# EasyEDA Pro project FPGA-G1.eprj, board logi Pi (continued)
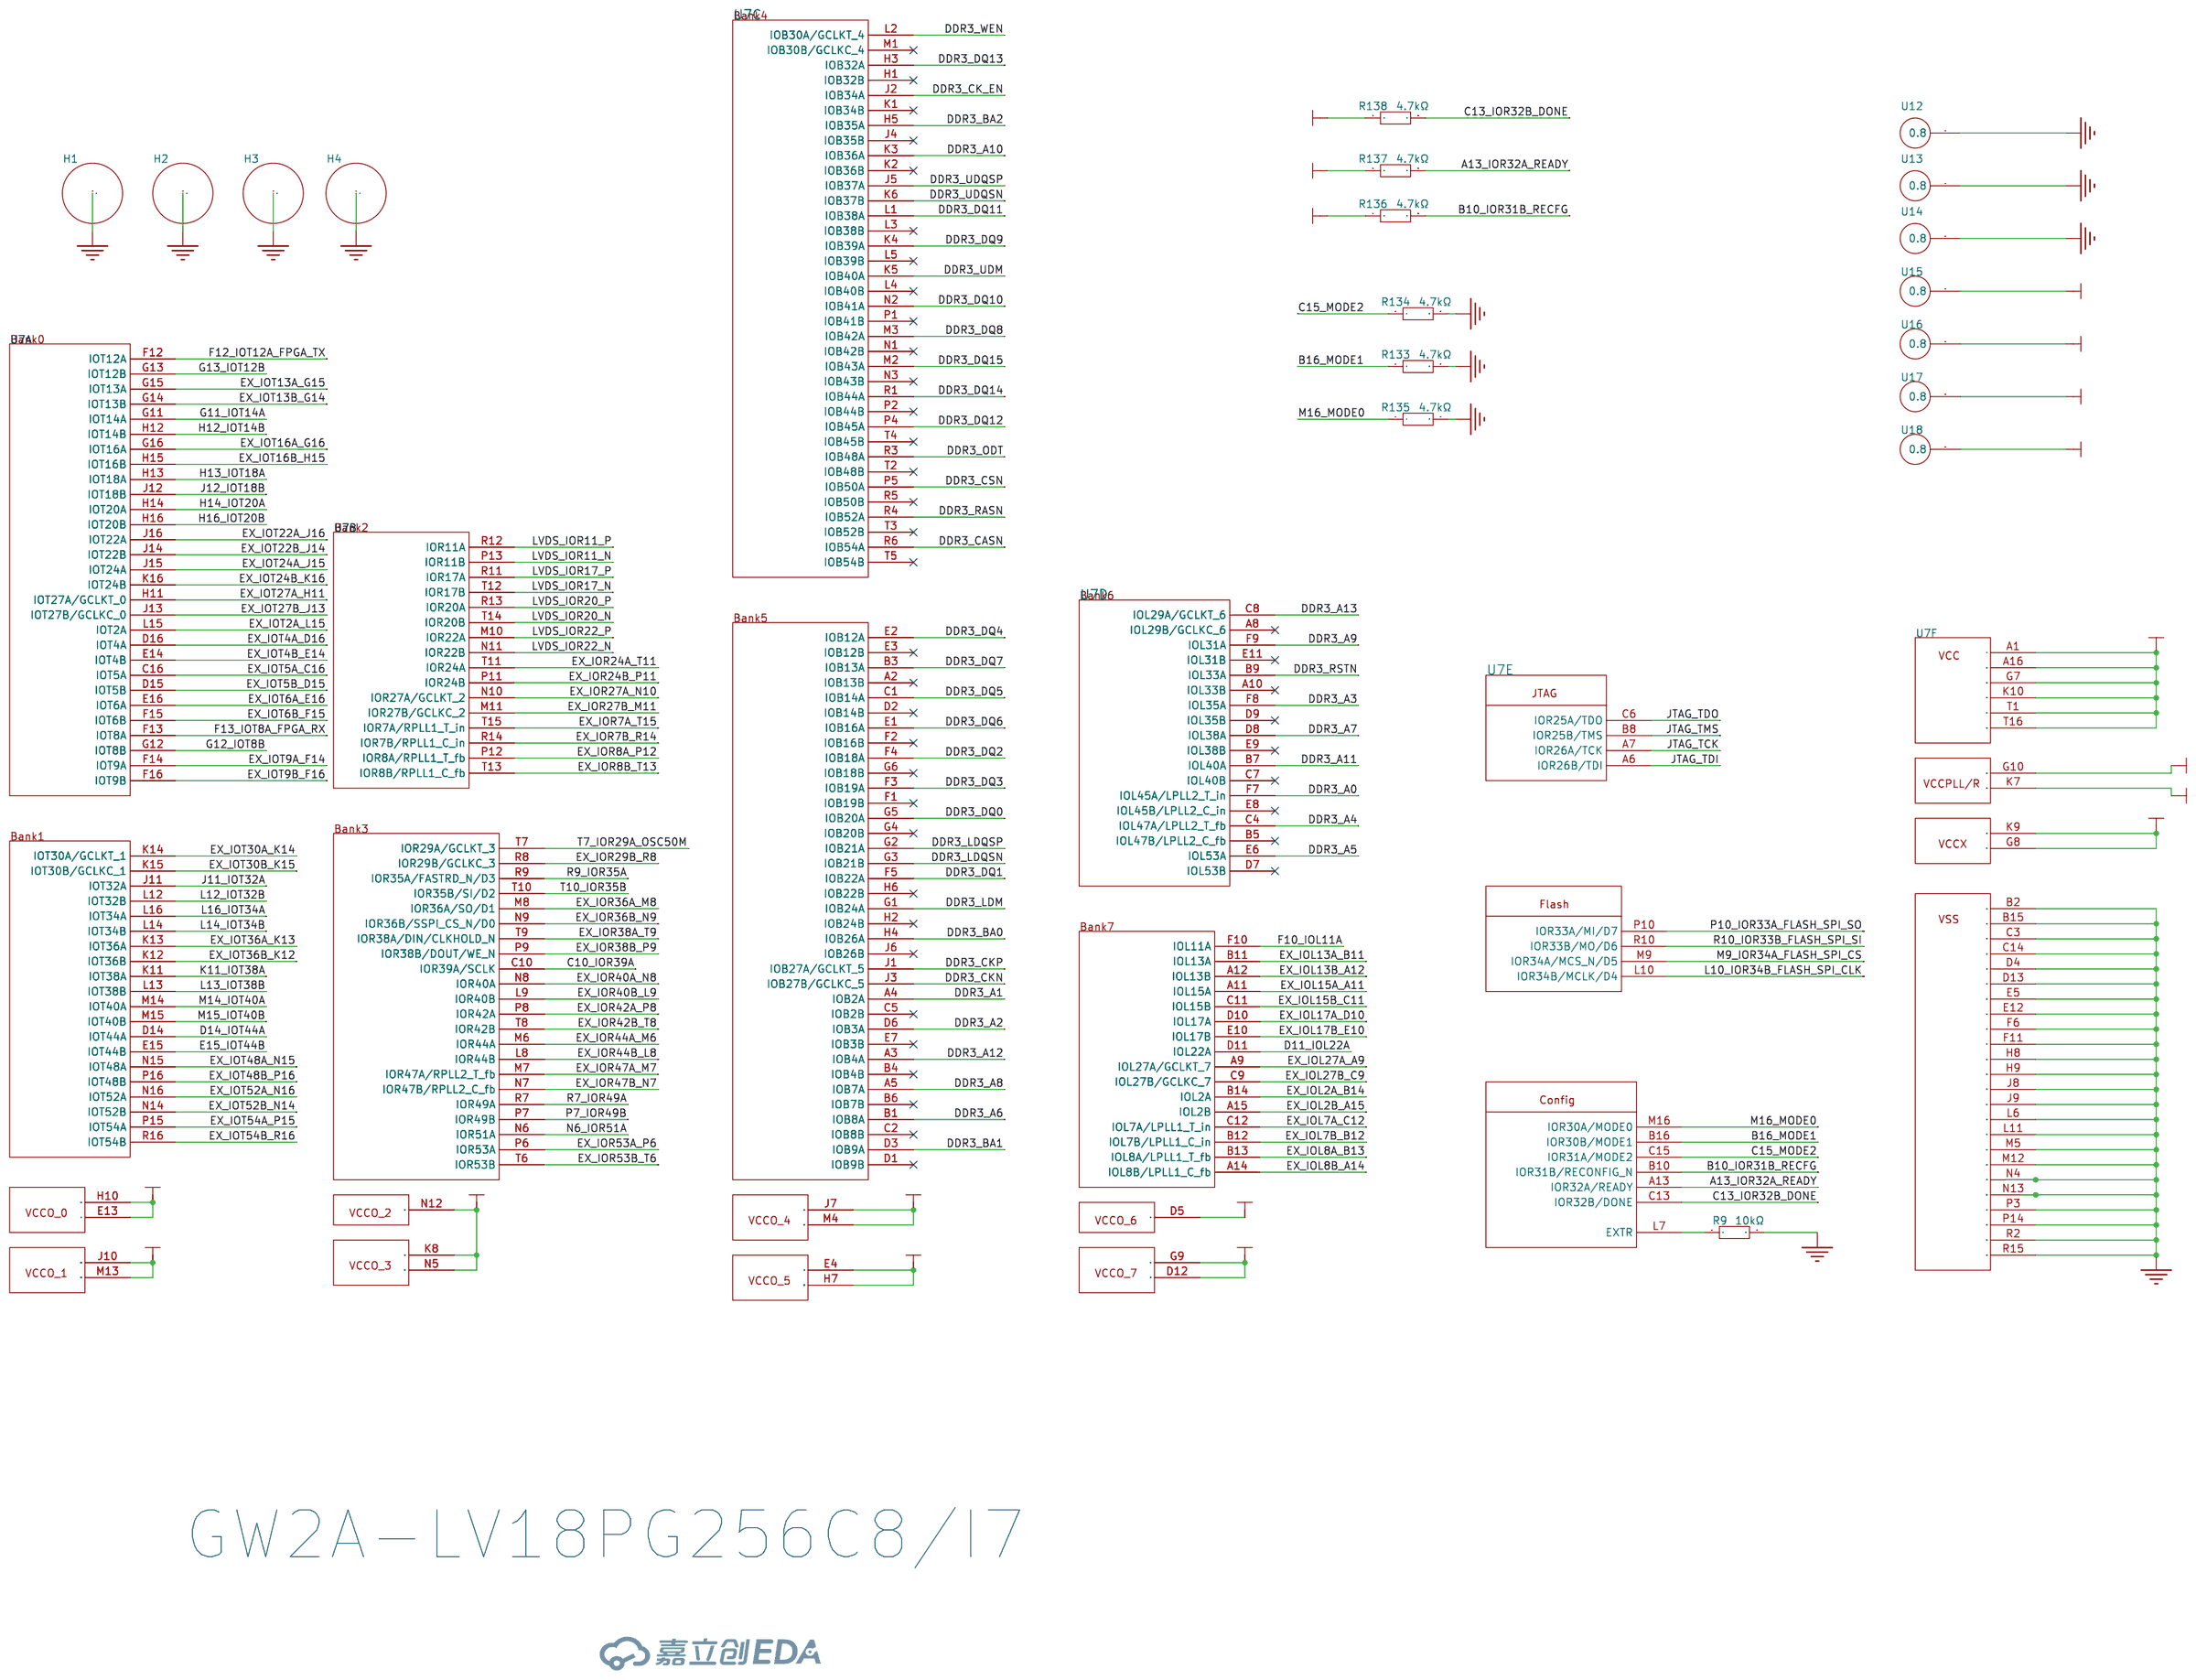
[diagram p0: FPGA]
## Routing (per net, layer and track width the routed paths; a pad name or vN(x,y) marks a point on that pad's centre or on a via; arc(x,y) is an arc through that point) (continued)
DDR3_DQ9: length 17.6
  Top Layer w0.109: U7.K4 v1(22.7,34.09) ; v1(13.53,31.44) 13.53,31.41 U29.C3
  Bottom Layer w0.109: v1(13.53,31.44) 13.55,31.44 14.38,32.27 14.54,32.27 14.92,32.65 15.07,32.65 15.15,32.73 15.15,32.88 15.22,32.96 15.4,32.96 15.47,32.88 15.47,32.73 15.55,32.65 17.46,32.65 17.7,32.89 17.7,33 17.7,33.01 17.7,33.12 17.82,33.24 17.93,33.24 17.93,33.23 18.04,33.23 18.17,33.36 18.17,33.47 18.16,33.47 18.16,33.58 18.28,33.7 18.39,33.7 18.4,33.7 18.51,33.7 18.74,33.93 20.01,33.93 20.16,34.08 20.16,34.66 20.39,34.89 20.78,34.89 20.86,34.97 20.86,35.54 20.94,35.62 21.11,35.62 21.19,35.53 21.19,34.73 21.27,34.66 21.44,34.66 21.52,34.73 21.52,35.54 21.59,35.62 21.76,35.62 21.84,35.54 21.84,34.97 21.92,34.89 22.27,34.89 22.38,34.77 22.38,34.33 22.62,34.09 22.7,34.09
DDR3_DQ10: length 17.7
  Top Layer w0.109: v1(20.7,30.09) 20.7,31.09 U7.N2 ; U29.C8 v1(10.3,29.84)
  Bottom Layer w0.109: v1(20.7,30.09) 20.11,29.5 19.67,29.5 17.37,27.2 13.07,27.2 12.99,27.12 12.99,26.9 12.91,26.83 12.74,26.83 12.66,26.9 12.66,27.12 12.59,27.2 12.41,27.2 12.33,27.12 12.33,26.9 12.26,26.83 12.08,26.83 12.01,26.9 12.01,27.12 11.93,27.2 10.73,27.2 9.91,28.02 9.91,29.45 v1(10.3,29.84)
DDR3_DQ11: length 17.6
  Top Layer w0.109: U29.C2 15.1,29.84 14.53,29.84 14.22,29.52 13.56,29.52 13.18,29.91 13.18,30.3 v1(13.53,30.65) ; 20.2,33.59 19.77,33.59 v1(19.27,33.09)
  Bottom Layer w0.109: v1(13.53,30.65) 13.53,30.92 13.65,31.05 13.99,31.05 14.06,30.97 14.06,30.59 14.14,30.51 14.31,30.51 14.39,30.59 14.39,30.97 14.47,31.05 14.64,31.05 14.72,30.97 14.72,30.59 14.8,30.51 14.97,30.51 15.05,30.59 15.05,30.97 15.12,31.05 17.39,31.05 17.51,30.93 17.51,30.93 17.55,30.88 17.66,30.88 17.79,31 17.79,31.11 17.52,31.38 17.52,31.49 17.64,31.61 17.75,31.61 18.03,31.33 18.12,31.33 18.29,31.5 18.29,31.61 18.1,31.8 18.1,31.92 18.25,32.07 18.31,32.07 18.52,31.86 18.63,31.86 18.76,31.98 18.76,32.09 18.58,32.27 18.58,32.4 18.84,32.66 19.85,32.66 20.04,32.85 20.04,33.11 19.87,33.28 19.46,33.28 v1(19.27,33.09)
DDR3_DQ12: length 17.7
  Top Layer w0.109: U29.A7 v1(11.9,28.24) ; U7.P4 v1(22.7,30.09)
  Bottom Layer w0.109: v1(22.7,30.09) 22.7,29.7 22.77,29.63 23.09,29.63 23.2,29.74 23.2,30.38 23.04,30.54 19.61,30.54 16.93,27.86 16.39,27.86 15.92,28.33 13.8,28.33 13.5,28.63 13.5,29.04 13.42,29.12 13.04,29.12 12.96,29.04 12.96,28.62 12.85,28.51 12.72,28.51 12.58,28.64 12.58,28.99 12.5,29.08 12.2,29.08 12.1,28.98 12.1,28.45 v1(11.9,28.24)
DDR3_DQ13: length 17.7
  Top Layer w0.109: U29.A2 15.12,28.26 14.37,28.26 12.85,29.77 12.85,30.62 ; v1(21.82,37.05) 22.2,36.67 U7.H3
  Bottom Layer w0.109: v1(21.82,37.05) 21.23,37.05 20.09,35.91 18.6,35.91 18.36,35.67 18.36,34.28 17.5,33.43 15.23,33.43 14.46,32.66 14.2,32.66 12.85,31.31 v1(12.85,30.64)
DDR3_DQ14: length 17.7
  Top Layer w0.109: U29.B8 v1(10.3,29.04) ; 20.2,29.58 v1(19.7,30.08)
  Bottom Layer w0.109: v1(19.7,30.08) 19.62,30.08 17.06,27.53 15.96,27.53 15.86,27.63 15.86,27.89 15.78,27.97 15.64,27.97 15.56,27.89 15.56,27.64 15.48,27.56 15.31,27.56 15.23,27.64 15.23,27.91 15.16,27.98 14.98,27.98 14.91,27.91 14.91,27.64 14.83,27.56 14.65,27.56 14.58,27.64 14.58,27.91 14.5,27.98 14.33,27.98 14.25,27.91 14.25,27.64 14.17,27.56 14,27.56 13.92,27.64 13.92,27.91 13.84,27.98 13.67,27.98 13.59,27.91 13.59,27.64 13.52,27.56 13.34,27.56 13.27,27.64 13.27,28.03 13.19,28.11 13.02,28.11 12.94,28.03 12.94,27.64 12.86,27.56 12.69,27.56 12.61,27.64 12.61,28.03 12.53,28.11 12.36,28.11 12.28,28.03 12.28,27.64 12.21,27.56 12.1,27.56 11.8,27.86 11.68,27.86 11.55,27.73 11.41,27.73 11.3,27.84 11.3,28.01 11.52,28.23 11.52,28.34 11.39,28.46 11.28,28.46 11.14,28.31 11.03,28.31 v1(10.3,29.04)
DDR3_DQ15: length 17.7
  Top Layer w0.109: U29.A3 v1(14.3,29.04) ; U7.M2 v1(21.7,32.09)
  Bottom Layer w0.109: v1(14.3,29.04) 14.23,29.11 13.93,29.11 13.82,29 13.82,28.77 13.93,28.66 17.26,28.66 19.47,30.87 19.76,30.87 19.83,30.94 19.83,31.23 19.91,31.31 20.08,31.31 20.16,31.23 20.16,30.94 20.24,30.87 20.41,30.87 20.49,30.94 20.49,31.71 20.57,31.79 20.74,31.79 20.82,31.71 20.82,30.94 20.89,30.87 21.07,30.87 21.15,30.94 21.15,31.71 21.22,31.79 21.4,31.79 21.47,31.71 21.47,31.53 21.53,31.48 21.87,31.48 21.94,31.41 21.94,31.25 21.87,31.19 21.6,31.19 21.49,31.08 21.49,30.92 21.55,30.87 21.99,30.87 ; v1(21.7,32.09) 22.07,32.09 22.24,31.93 22.24,31.11 21.99,30.87
DDR3_LDM: length 21.3
  Top Layer w0.109: U29.E7 12.11,31.84 12.35,32.08 12.35,33.5 v1(11.96,33.88) ; U7.G1 v1(19.7,38.09)
  SIG03 w0.109: v1(11.96,33.88) 12.25,34.17 12.36,34.17 12.54,33.99 12.65,33.99 12.77,34.11 12.77,34.22 12.59,34.4 12.59,34.51 13.36,35.28 13.36,35.66 13.44,35.74 14.11,35.74 14.19,35.81 14.19,35.99 14.11,36.06 13.44,36.06 13.36,36.14 13.36,36.31 13.44,36.39 14.01,36.39 14.09,36.47 14.09,36.64 14.01,36.72 13.44,36.72 13.36,36.8 13.36,37.22 13.6,37.45 13.65,37.45 13.73,37.53 13.73,37.83 13.81,37.91 13.98,37.91 14.06,37.83 14.06,37.53 14.14,37.45 14.31,37.45 14.39,37.53 14.39,37.8 14.46,37.88 14.64,37.88 14.72,37.8 14.72,37.53 14.79,37.45 16.11,37.45 16.19,37.53 16.19,37.59 16.27,37.67 16.44,37.67 16.52,37.59 16.52,37.53 16.6,37.45 16.77,37.45 16.85,37.53 16.85,37.68 16.92,37.76 17.1,37.76 17.18,37.68 17.18,37.53 17.25,37.45 17.43,37.45 17.5,37.53 17.5,37.63 17.58,37.7 17.75,37.7 17.83,37.63 17.83,37.53 17.91,37.45 18.38,37.45 18.53,37.3 18.53,36.85 18.66,36.72 18.97,36.72 ; 18.97,36.72 19.15,36.9 19.15,37.12 19.7,37.67 v1(19.7,38.09)
DDR3_LDQSN: length 21.2
  Top Layer w0.104: U29.G3 v1(14.3,33.04) ; v1(21.66,38.09) 22.16,37.59 U7.G3
  SIG03 w0.104: v1(14.3,33.04) 14.05,33.29 14.05,34.63 14.17,34.75 14.6,34.75 14.85,35 14.85,36.27 14.92,36.34 15.1,36.34 15.18,36.27 15.18,35 15.43,34.75 17.33,34.75 17.58,35 17.58,36.75 17.65,36.82 17.83,36.82 17.91,36.75 17.91,35 18.16,34.75 18.71,34.75 19.16,35.2 19.16,35.61 18.91,35.86 18.91,35.96 19.04,36.09 19.15,36.09 19.4,35.84 19.75,35.84 20.06,36.15 20.06,36.5 19.81,36.76 19.81,36.86 19.94,36.99 20.04,36.99 20.49,36.53 20.78,36.53 21.11,36.86 21.11,37.48 21.66,38.04 v1(21.66,38.09)
DDR3_LDQSP: length 21.2
  Top Layer w0.104: 21.2,37.57 v1(20.7,38.07) ; v1(13.5,33.04) 13.9,32.64 U29.F3
  SIG03 w0.104: v1(13.5,33.04) 13.75,33.29 13.75,34.76 14.04,35.05 14.47,35.05 14.55,35.13 14.55,36.39 14.8,36.64 15.23,36.64 15.48,36.39 15.48,35.13 15.56,35.05 17.2,35.05 17.27,35.13 17.27,36.87 17.53,37.13 17.96,37.13 18.21,36.87 18.21,35.13 18.28,35.05 18.48,35.05 18.81,35.38 18.81,35.54 18.61,35.73 18.61,36.09 18.91,36.4 19.27,36.4 19.52,36.15 19.63,36.15 19.75,36.27 19.75,36.38 19.5,36.63 19.5,36.99 19.81,37.29 20.17,37.29 20.42,37.04 20.52,37.04 20.71,37.23 20.71,38.07 v1(20.7,38.07)
DDR3_ODT: length 22.2
  Top Layer w0.109: U29.K1 16.7,36.24 ; U7.R3 v1(21.7,29.09)
  SIG04 w0.109: 16.7,36.24 16.95,36.24 17.85,37.14 21.15,37.14 21.9,36.4 22.01,36.4 22.24,36.63 22.35,36.63 22.47,36.51 22.47,36.4 22.24,36.16 22.24,36.06 22.49,35.81 22.49,34.98 23.09,34.38 23.09,33.19 22.32,32.42 22.32,31.56 22.24,31.49 20.9,31.49 20.83,31.41 20.83,31.24 20.9,31.16 22.24,31.16 22.32,31.08 22.32,30.91 22.24,30.83 20.75,30.83 20.67,30.75 20.67,30.58 20.75,30.5 22.24,30.5 22.32,30.43 22.32,29.71 v1(21.7,29.09)
  vias: v1(16.7,36.24)
DDR3_RASN: length 32.1
  Top Layer w0.109: U7.R4 v1(22.7,29.09) ; v1(13.22,34.32) 13.22,34.38 13.88,35.04 U29.J3
  SIG04 w0.109: v1(22.7,29.09) 22.09,28.48 20.38,28.48 19.21,29.64 18.08,29.64 18,29.72 18,29.98 17.93,30.06 17.75,30.06 17.68,29.98 17.68,29.72 17.6,29.64 17.43,29.64 17.35,29.72 17.35,29.98 17.27,30.06 17.1,30.06 17.02,29.98 17.02,29.72 16.94,29.64 16.77,29.64 16.69,29.72 16.69,29.98 16.62,30.06 16.44,30.06 16.36,29.98 16.36,29.72 16.29,29.64 16.11,29.64 16.04,29.72 16.04,29.98 15.96,30.06 15.79,30.06 15.71,29.98 15.71,29.72 15.63,29.64 15.46,29.64 15.38,29.72 15.38,29.98 15.3,30.06 15.13,30.06 15.05,29.98 15.05,29.72 14.98,29.64 14.8,29.64 14.73,29.72 14.73,29.98 14.65,30.06 14.48,30.06 14.4,29.98 14.4,29.72 14.32,29.64 13.13,29.64 12.38,30.39 12.38,33.79 12.91,34.32 v1(13.22,34.32)
  Bottom Layer w0.109: v1(13.22,34.32) 12.75,34.79 12.75,37.72 12.43,38.04 12.43,40.56 10.13,42.85 R128.1
DDR3_RSTN: length 26.1
  Top Layer w0.109: 15.9,41.05 16.7,41.85 v1(16.7,41.91) ; 15.9,41.05 18.47,43.6 18.47,43.63 ; 15.9,41.05 15.5,40.65 U29.T2 ; U7.B9 v1(27.7,42.09)
  SIG04 w0.109: v1(16.7,41.91) 17.85,43.05 17.96,43.05 18.12,42.9 18.22,42.9 18.35,43.02 18.35,43.13 18.19,43.29 18.19,43.39 18.31,43.52 18.42,43.52 18.58,43.36 18.69,43.36 18.81,43.48 18.81,43.59 18.65,43.75 18.65,43.86 19.22,44.43 20.22,44.43 20.3,44.35 20.3,43.96 20.38,43.88 20.55,43.88 20.63,43.96 20.63,44.35 20.71,44.43 20.88,44.43 20.96,44.35 20.96,43.96 21.03,43.88 21.21,43.88 21.28,43.96 21.28,44.35 21.36,44.43 21.53,44.43 21.61,44.35 21.61,43.96 21.69,43.88 21.86,43.88 21.94,43.96 21.94,44.35 22.02,44.43 23.68,44.43 23.99,44.12 23.99,44.02 23.83,43.86 23.83,43.76 23.96,43.63 24.07,43.63 24.22,43.78 24.33,43.78 25.51,42.6 25.92,42.6 26.15,42.37 26.15,40.96 26.46,40.64 27.13,40.64 27.7,41.21 v1(27.7,42.09)
DDR3_UDM: length 17.7
  Top Layer w0.109: U29.D3 v1(14.3,31.44) ; U7.K5 24.2,34.76 v1(23.7,35.27)
  Bottom Layer w0.109: v1(14.3,31.44) 14.3,31.72 14.41,31.83 14.76,31.83 14.84,31.9 14.84,32.11 14.91,32.19 15.09,32.19 15.17,32.11 15.17,31.9 15.24,31.83 17.34,31.83 17.68,32.16 17.68,32.36 17.81,32.49 18.01,32.49 18.14,32.62 18.14,32.82 18.27,32.96 18.47,32.96 18.6,33.09 18.6,33.29 18.74,33.42 18.94,33.42 19.12,33.61 20.1,33.61 20.17,33.53 20.17,33.44 20.25,33.37 20.42,33.37 20.5,33.44 20.5,33.53 20.58,33.61 20.99,33.61 21.07,33.68 21.07,33.85 21.15,33.93 21.32,33.93 21.4,33.85 21.4,33.68 21.47,33.61 21.97,33.61 22.05,33.68 22.05,33.87 22.13,33.95 22.3,33.95 22.38,33.87 22.38,33.68 22.46,33.61 23.41,33.61 23.7,33.89 23.7,34.38 23.62,34.46 22.96,34.46 22.71,34.71 22.71,34.99 22.82,35.1 23.03,35.1 23.35,34.79 23.62,34.79 23.7,34.87 v1(23.7,35.27)
DDR3_UDQSN: length 17.6
  Top Layer w0.104: U7.K6 v1(24.7,34.09) ; U29.B7 v1(11.1,29.04)
  Bottom Layer w0.104: v1(11.1,29.04) 11.38,29.04 11.63,29.29 11.95,29.29 12.19,29.52 17.67,29.52 21.12,32.98 21.68,32.98 21.75,32.9 21.75,32.75 21.83,32.68 22.01,32.68 22.08,32.75 22.08,32.9 22.15,32.98 24.04,32.98 24.7,33.64 v1(24.7,34.09)
DDR3_UDQSP: length 17.6
  Top Layer w0.104: 24.2,35.62 24.7,35.12 ; U29.C7 v1(11.1,29.84)
  Bottom Layer w0.104: 24.73,35.08 v1(24.72,35.09) 24.72,34.74 24.18,34.19 24.18,33.92 23.54,33.28 21,33.28 17.54,29.83 12.06,29.83 11.83,29.59 11.51,29.59 11.26,29.84 v1(11.1,29.84)
DDR3_WEN: length 29.4
  Top Layer w0.109: v1(15.1,37.03) 14.7,36.64 U29.L3 ; U7.L2 v1(20.7,34.09)
  SIG04 w0.109: v1(15.1,37.03) 15.06,37 15.06,36.03 15.26,35.83 17.02,35.83 18.01,36.82 21.01,36.82 22.16,35.67 22.16,33.75 22.24,33.68 22.34,33.68 22.42,33.6 22.42,33.43 22.34,33.35 22.24,33.35 22.16,33.27 22.16,32.73 21.99,32.55 21.82,32.55 21.75,32.63 21.75,33.34 21.67,33.42 21.5,33.42 21.42,33.34 21.42,32.55 21.34,32.48 21.17,32.48 21.09,32.55 21.09,33.34 21.01,33.42 20.84,33.42 20.76,33.33 20.76,31.81 20.59,31.64 20.39,31.64 20.26,31.77 20.26,33.42 20.7,33.86 v1(20.7,34.09)
  Bottom Layer w0.109: R129.1 13.08,41.79 13.08,39.05 15.09,37.03
E15_IOT44B: length 18.9
  Top Layer w0.109: v1(34.68,40.09) 34.2,39.62 U7.E15 ; v1(35.84,50.75) 35.84,50.75 35.84,51.44 35.55,51.73 34.98,51.73 34.79,51.54 33.91,51.54 33.21,52.24 33.21,53.67 33.5,53.96 U1.14
  SIG04 w0.109: v1(35.84,50.75) 35.24,50.75 34.46,49.96 34.46,40.32 v1(34.68,40.09)
EX_IOL2A_B14: length 46.8
  Top Layer w0.104: v1(32.2,44.82) 32.98,44.82 33.7,44.09 33.7,43.09 U7.B14
  SIG03 w0.104: H5.17 4.52,40.27 4.6,40.34 4.6,41.46 4.85,41.71 6.63,41.71 7.52,42.6 7.52,43.45 11.13,47.06 11.13,49.76 13.78,52.41 21.96,52.41 22.21,52.15 22.21,51.59 22.29,51.52 22.47,51.52 22.54,51.59 22.54,52.15 22.79,52.41 27.56,52.41 32.68,47.28 32.68,44.96 32.54,44.82 v1(32.2,44.82)
EX_IOL2B_A15: length 46.8
  Top Layer w0.104: U7.A15 34.2,44.09 32.85,45.44 v1(32.2,45.44)
  SIG03 w0.104: v1(32.2,45.44) 32.38,45.44 32.38,47.16 31.03,48.51 30.92,48.51 30.69,48.28 30.59,48.28 30.46,48.41 30.46,48.51 30.69,48.74 30.69,48.85 30.56,48.97 30.46,48.97 30.23,48.75 30.13,48.75 30,48.87 30,48.98 30.23,49.2 30.23,49.31 30.1,49.44 30,49.44 29.77,49.21 29.66,49.21 29.54,49.34 29.54,49.44 29.76,49.67 29.76,49.77 27.43,52.1 22.92,52.1 22.84,52.03 22.84,51.46 22.59,51.21 22.16,51.21 21.91,51.46 21.91,52.03 21.83,52.1 13.91,52.1 11.45,49.65 11.45,46.66 7.83,43.04 7.83,42.48 6.76,41.4 4.97,41.4 4.9,41.33 4.9,40.34 4.97,40.27 H5.18
EX_IOL7A_C12: length 46.9
  Top Layer w0.104: U7.C12 v1(31.7,42.09)
  SIG03 w0.104: v1(31.7,42.09) 31.35,42.44 31.12,42.44 30.4,43.16 30.4,44.05 29.97,44.47 26.49,44.47 25.83,45.14 25.83,45.98 25.32,46.49 24.85,46.49 24.6,46.74 24.6,48.13 24.53,48.21 24.34,48.21 24.27,48.13 24.27,46.74 23.99,46.46 20.37,46.46 19,47.82 18.67,47.82 18.6,47.75 18.6,46.96 18.35,46.71 17.91,46.71 17.66,46.96 17.66,47.75 17.59,47.82 17.41,47.82 17.34,47.75 17.34,46.96 17.08,46.71 16.65,46.71 16.4,46.96 16.4,47.75 16.32,47.82 16.32,47.82 15.71,47.82 14.88,46.99 14.88,46.88 14.91,46.85 14.91,46.74 14.79,46.61 14.68,46.61 14.65,46.65 14.54,46.65 8.62,40.73 8.62,37.02 7.89,36.28 5.19,36.28 4.9,35.99 4.9,35.26 4.97,35.19 H5.22
EX_IOL7B_B12: length 46.9
  Top Layer w0.104: U7.B12 v1(31.7,43.09)
  SIG03 w0.104: v1(31.7,43.09) 31.35,42.74 31.25,42.74 30.71,43.29 30.71,44.17 30.1,44.78 26.81,44.78 26.22,45.36 26.22,46.17 25.6,46.79 24.98,46.79 24.9,46.87 24.9,48.26 24.65,48.51 24.22,48.51 23.97,48.26 23.97,46.9 23.89,46.82 20.64,46.82 19.33,48.13 18.85,48.13 18.85,48.13 18.55,48.13 18.3,47.88 18.3,47.09 18.22,47.01 18.04,47.01 17.97,47.09 17.97,47.88 17.72,48.13 17.28,48.13 17.03,47.88 17.03,47.09 16.96,47.01 16.78,47.01 16.7,47.09 16.7,47.88 16.45,48.13 15.34,48.13 8.12,40.91 8.12,37.51 7.23,36.63 5.1,36.63 4.6,36.12 4.6,35.26 4.52,35.19 H5.21
EX_IOL8A_B13: length 46.9
  Top Layer w0.104: U7.B13 v1(32.7,43.09)
  SIG03 w0.104: 3.48,42.81 4.52,42.81 4.6,42.88 4.6,43.6 5.23,44.23 6.71,44.23 7.15,44.67 7.15,46.33 7.45,46.63 9.53,46.63 10.08,47.18 10.08,50.84 12.42,53.18 18.03,53.18 18.34,53.49 29.58,53.49 30.29,52.78 30.29,50.84 33.19,47.93 33.19,43.58 v1(32.7,43.09)
EX_IOL8B_A14: length 46.8
  Top Layer w0.104: U7.A14 32.62,44.17 32.21,44.17 v1(32.2,44.17)
  SIG03 w0.104: 6.02,42.81 4.97,42.81 4.9,42.88 4.9,43.47 5.35,43.92 6.84,43.92 7.45,44.54 7.45,46.2 7.58,46.33 9.85,46.33 10.55,47.03 10.55,50.6 12.83,52.87 18.16,52.87 18.47,53.18 19.06,53.18 19.13,53.11 19.13,52.85 19.21,52.77 19.39,52.77 19.46,52.85 19.46,53.11 19.53,53.18 19.71,53.18 19.79,53.11 19.79,52.85 19.86,52.77 20.04,52.77 20.12,52.85 20.12,53.11 20.19,53.18 29.45,53.18 29.98,52.65 29.98,50.71 32.89,47.81 32.89,44.51 32.54,44.17 v1(32.2,44.17)
EX_IOL13A_B11: length 46.8
  Top Layer w0.104: v1(21.94,47.2) 22.06,47.32 22.06,47.32 24.05,47.32 26.88,44.49 30.41,44.49 30.65,44.25 30.65,43.04 U7.B11
  SIG03 w0.104: v1(21.94,47.2) 21.72,47.42 20.72,47.42 19.84,48.3 19.84,48.97 19.23,49.58 17.69,49.58 17.44,49.84 17.44,51 17.36,51.07 17.18,51.07 17.11,51 17.11,49.84 16.86,49.58 16.42,49.58 16.17,49.84 16.17,51 16.1,51.07 15.92,51.07 15.84,51 15.84,49.84 15.59,49.58 14.9,49.58 14.82,49.51 14.82,48.54 14.57,48.29 14.14,48.29 13.89,48.54 13.89,49.51 13.81,49.58 13.47,49.58 12.48,48.59 12.48,46.07 7.59,41.18 7.59,39.11 7.34,38.86 5.27,38.86 4.9,38.49 4.9,37.8 4.97,37.73 H5.20
EX_IOL13B_A12: length 46.9
  Top Layer w0.104: 21.94,47.79 22.07,47.79 22.24,47.63 24.18,47.63 27.01,44.79 30.54,44.79 31.06,44.27 31.06,43.73 U7.A12
  SIG03 w0.104: 21.94,47.79 21.87,47.73 21,47.73 20.35,48.38 20.35,49.12 19.58,49.89 17.81,49.89 17.74,49.96 17.74,51.12 17.49,51.38 17.06,51.38 16.8,51.12 16.8,49.96 16.73,49.89 16.55,49.89 16.48,49.96 16.48,51.12 16.22,51.38 15.79,51.38 15.54,51.12 15.54,49.96 15.47,49.89 14.77,49.89 14.52,49.64 14.52,48.67 14.44,48.59 14.26,48.59 14.19,48.67 14.19,49.64 13.92,49.9 13.16,49.9 12.13,48.87 12.13,46.37 7.28,41.53 7.28,39.24 7.21,39.16 5.14,39.16 4.6,38.62 4.6,37.8 4.52,37.73 H5.19
  vias: v1(21.94,47.8)
EX_IOL15A_A11: length 46.8
  Top Layer w0.104: U7.A11 v1(29.7,44.09)
  SIG04 w0.104: v1(29.7,44.09) 29.13,44.09 26.52,46.7 26.52,47.4 24.65,49.27 12.79,49.27 10.8,47.28 10.8,47.18 11,46.98 11,46.88 10.87,46.75 10.77,46.75 10.57,46.95 10.47,46.95 10.34,46.82 10.34,46.71 10.54,46.52 10.54,46.41 10.41,46.28 10.31,46.28 10.11,46.48 10,46.48 9.88,46.36 9.88,46.25 10.08,46.05 10.08,45.95 9.95,45.82 9.84,45.82 9.64,46.02 9.54,46.02 9.41,45.89 9.41,45.79 9.61,45.59 9.61,45.48 9.48,45.36 9.38,45.36 9.18,45.56 9.08,45.56 8.95,45.43 8.95,45.32 9.15,45.13 9.15,45.02 9.02,44.89 8.92,44.89 8.72,45.09 8.61,45.09 8.49,44.97 8.49,44.86 8.68,44.66 8.68,44.56 8.56,44.43 8.45,44.43 8.25,44.63 8.15,44.63 8.02,44.5 8.02,44.4 8.22,44.2 8.22,44.09 8.09,43.97 7.99,43.97 7.79,44.17 7.69,44.17 7.39,43.87 7.39,34.3 6.88,33.78 5.34,33.78 4.9,33.35 4.9,32.72 4.97,32.65 H5.24
EX_IOL15B_C11: length 46.9
  Top Layer w0.104: U7.C11 29.7,41.09
  SIG04 w0.104: v1(29.72,41.09) 30.27,41.65 30.27,44.28 30.05,44.51 29.15,44.51 26.83,46.83 26.83,47.53 24.78,49.57 14.2,49.57 14.12,49.65 14.12,49.78 14.05,49.85 13.87,49.85 13.8,49.78 13.8,49.65 13.72,49.57 12.66,49.57 7.09,44 7.09,34.6 6.57,34.09 5.21,34.09 4.6,33.47 4.6,32.72 4.52,32.65 H5.23
EX_IOL17A_D10: length 46.9
  Top Layer w0.104: U7.D10 v1(28.7,41.09)
  SIG04 w0.104: v1(28.7,41.09) 28.7,41.99 27.29,43.4 27.19,43.4 26.95,43.16 26.85,43.16 26.72,43.29 26.72,43.39 26.96,43.63 26.96,43.74 26.83,43.86 26.72,43.86 26.49,43.63 26.38,43.63 26.26,43.75 26.26,43.86 26.49,44.09 26.49,44.2 26.37,44.33 26.26,44.33 26.03,44.09 25.92,44.09 25.79,44.22 25.79,44.32 26.03,44.56 26.03,44.66 25.9,44.79 25.8,44.79 25.56,44.55 25.46,44.55 25.33,44.68 25.33,44.78 25.57,45.02 25.57,45.13 25.27,45.43 25.27,46.23 25.01,46.48 13.65,46.48 8.82,41.65 8.82,30.54 7.01,28.72 5.11,28.72 4.9,28.52 4.9,27.64 4.97,27.57 H5.28
EX_IOL17B_E10: length 46.8
  Top Layer w0.104: U7.E10 28.7,40.09
  SIG04 w0.104: H5.27 4.52,27.57 4.6,27.64 4.6,28.64 4.98,29.03 6.89,29.03 8.52,30.66 8.52,41.78 13.56,46.82 22.56,46.82 22.63,46.9 22.63,47.06 22.71,47.13 22.89,47.13 22.96,47.06 22.96,46.9 23.03,46.82 23.21,46.82 23.29,46.9 23.29,47.06 23.36,47.13 23.54,47.13 23.62,47.06 23.62,46.9 23.69,46.82 25.1,46.82 25.57,46.35 25.57,45.55 29.12,42.01 29.12,40.52 v1(28.7,40.11)
EX_IOL27A_A9: length 46.9
  Top Layer w0.104: U7.A9 v1(27.7,44.09)
  SIG04 w0.104: v1(27.7,44.09) 25.83,45.96 25.83,47.08 24.32,48.59 19.04,48.59 18.97,48.52 18.97,48.15 18.89,48.08 18.71,48.08 18.64,48.15 18.64,48.52 18.56,48.59 18.38,48.59 18.31,48.52 18.31,48.15 18.24,48.08 18.06,48.08 17.98,48.15 17.98,48.52 17.91,48.59 17.73,48.59 17.66,48.52 17.66,48.15 17.58,48.08 17.4,48.08 17.33,48.15 17.33,48.52 17.25,48.59 17.07,48.59 17,48.52 17,48.15 16.93,48.08 16.75,48.08 16.67,48.15 16.67,48.52 16.6,48.59 16.42,48.59 16.34,48.52 16.34,48.15 16.27,48.08 16.09,48.08 16.02,48.15 16.02,48.52 15.94,48.59 15.76,48.59 15.69,48.52 15.69,48.15 15.62,48.08 15.44,48.08 15.36,48.15 15.36,48.52 15.29,48.59 13.48,48.59 8.09,43.2 8.09,32.05 7.31,31.27 5.19,31.27 4.9,30.98 4.9,30.18 4.97,30.11 H5.26
EX_IOL27B_C9: length 46.9
  Top Layer w0.104: U7.C9 28.7,42.09 v1(28.7,43.09)
  SIG04 w0.104: v1(28.7,43.09) 28.7,43.74 28.25,44.2 28.25,44.3 28.35,44.41 28.35,44.51 28.23,44.64 28.12,44.64 28.02,44.53 27.91,44.53 27.78,44.66 27.78,44.77 27.89,44.87 27.89,44.98 27.76,45.1 27.66,45.1 27.55,45 27.45,45 27.32,45.12 27.32,45.23 27.43,45.34 27.43,45.44 27.3,45.57 27.19,45.57 27.09,45.46 26.98,45.46 26.86,45.59 26.86,45.69 26.96,45.8 26.96,45.9 26.84,46.03 26.73,46.03 26.63,45.92 26.52,45.92 26.13,46.31 26.13,47.26 24.45,48.95 13.41,48.95 7.79,43.33 7.79,32.18 7.18,31.57 5.07,31.57 4.6,31.1 4.6,30.18 4.52,30.11 H5.25
EX_IOR7A_T15: length 36.7
  Top Layer w0.104: U7.T15 34.2,27.59 33.17,26.56 31.34,26.56 v1(30.97,26.19)
  SIG03 w0.104: v1(30.97,26.19) 30.97,26.04 28.9,23.97 25.17,23.97 22.6,21.4 22.6,20.97 21.06,19.42 20.28,19.42 19.74,18.87 14.49,18.87 14.41,18.8 14.41,18.65 14.34,18.58 14.16,18.58 14.08,18.65 14.08,18.8 14.01,18.87 13.83,18.87 13.76,18.8 13.76,18.65 13.68,18.58 13.5,18.58 13.43,18.65 13.43,18.8 13.35,18.87 13.18,18.87 13.1,18.8 13.1,18.65 13.03,18.58 12.85,18.58 12.77,18.65 12.77,18.8 12.7,18.87 12.52,18.87 12.45,18.8 12.45,18.65 12.37,18.58 12.19,18.58 12.12,18.65 12.12,18.8 12.04,18.87 11.86,18.87 11.79,18.8 11.79,18.65 11.72,18.58 11.54,18.58 11.46,18.65 11.46,18.8 11.39,18.87 10.52,18.87 9.91,18.26 9.91,17.35 9.52,16.96 7.76,16.96 7.32,17.41 H5.36
EX_IOR7B_R14: length 36.7
  Top Layer w0.104: U7.R14 33.24,29.59 33.73,29.1 33.73,27.55 33.04,26.86 31.08,26.86 v1(30.97,26.75)
  SIG03 w0.104: H5.35 3.99,17.41 5.15,18.57 7.45,18.57 8.06,19.18 19.46,19.18 24.6,24.32 28.54,24.32 v1(30.97,26.75)
EX_IOR8A_P12: length 36.7
  Top Layer w0.104: 31.2,30.59 30.7,30.09
  SIG03 w0.104: H5.31 3.55,22.49 4.77,21.27 7.79,21.27 7.86,21.35 7.86,22 7.93,22.07 8.11,22.07 8.19,22 8.19,21.35 8.26,21.27 8.44,21.27 8.51,21.35 8.51,22 8.59,22.07 8.77,22.07 8.84,22 8.84,21.35 8.92,21.27 9.23,21.27 9.3,21.35 9.3,21.57 9.38,21.64 9.56,21.64 9.63,21.57 9.63,21.35 9.7,21.27 12.79,21.27 13.36,21.84 19.33,21.84 19.78,22.29 19.78,23.51 22.61,26.34 27.03,26.34 29.21,28.52 29.21,29.39 29.43,29.61 30.23,29.61 v1(30.71,30.09)
EX_IOR8B_T13: length 36.7
  Top Layer w0.104: U7.T13 32.2,28.58 v1(30.96,27.33)
  SIG03 w0.104: 3.48,19.95 4.57,18.86 7.05,18.86 7.76,19.56 8.55,19.56 8.62,19.63 8.62,20.01 8.7,20.09 8.88,20.09 8.95,20.01 8.95,19.63 9.03,19.56 9.21,19.56 9.28,19.63 9.28,20.01 9.35,20.09 9.53,20.09 9.61,20.01 9.61,19.63 9.68,19.56 9.86,19.56 9.94,19.63 9.94,20.01 10.01,20.09 10.19,20.09 10.26,20.01 10.26,19.63 10.34,19.56 10.52,19.56 10.59,19.63 10.59,20.01 10.66,20.09 10.84,20.09 10.92,20.01 10.92,19.63 10.99,19.56 19.41,19.56 24.93,25.09 28.68,25.09 30.93,27.33 v1(30.96,27.33)
EX_IOR24A_T11: length 36.7
  Top Layer w0.104: U7.T11 29.7,28.09
  SIG03 w0.104: 6.02,19.95 7.03,20.96 11.34,20.96 11.41,20.89 11.41,20.11 11.49,20.04 11.67,20.04 11.74,20.11 11.74,20.89 11.82,20.96 12,20.96 12.07,20.89 12.07,20.11 12.14,20.04 12.32,20.04 12.4,20.11 12.4,20.89 12.47,20.96 12.65,20.96 12.73,20.89 12.73,20.11 12.8,20.04 12.98,20.04 13.05,20.11 13.05,20.89 13.13,20.96 13.31,20.96 13.38,20.89 13.38,20.11 13.45,20.04 13.63,20.04 13.71,20.11 13.71,20.89 13.78,20.96 14.44,20.96 14.95,21.47 15.29,21.47 15.36,21.4 15.36,21.24 15.43,21.17 15.61,21.17 15.69,21.24 15.69,21.4 15.76,21.47 19.79,21.47 20.28,21.96 20.28,23.5 22.3,25.51 28.61,25.51 29.7,26.61 v1(29.7,28.11)
EX_IOR24B_P11: length 36.7
  Top Layer w0.104: U7.P11 29.7,30.09
  SIG03 w0.104: H5.32 7.69,22.49 7.77,22.56 7.77,23.53 7.84,23.6 8.02,23.6 8.1,23.53 8.1,22.56 8.17,22.49 8.35,22.49 8.42,22.56 8.42,23.53 8.5,23.6 8.68,23.6 8.75,23.53 8.75,22.56 8.83,22.49 9.01,22.49 9.08,22.56 9.08,23.53 9.15,23.6 9.33,23.6 9.41,23.53 9.41,22.56 9.48,22.49 10.5,22.49 11.89,23.88 13.33,23.88 13.41,23.8 13.41,22.69 13.48,22.62 13.66,22.62 13.73,22.69 13.73,23.8 13.81,23.88 19.53,23.88 22.28,26.63 26.72,26.63 28.34,28.25 28.34,29.39 28.56,29.61 28.88,29.61 29.36,30.09 29.7,30.09
  vias: v1(29.72,30.09)
EX_IOR27A_N10: length 36.7
  Top Layer w0.104: U7.N10 28.7,31.09
  SIG03 w0.104: 28.7,31.09 28.29,30.68 28.29,29.83 25.85,27.39 20.43,27.39 17.3,24.26 17.02,24.26 16.95,24.34 16.95,25.11 16.88,25.19 16.7,25.19 16.62,25.11 16.62,24.34 16.55,24.26 16.37,24.26 16.3,24.34 16.3,25.11 16.22,25.19 16.04,25.19 15.97,25.11 15.97,24.34 15.89,24.26 15.71,24.26 15.64,24.34 15.64,25.11 15.57,25.19 15.39,25.19 15.31,25.11 15.31,24.34 15.24,24.26 15.06,24.26 14.98,24.34 14.98,25.11 14.91,25.19 14.73,25.19 14.66,25.11 14.66,24.34 14.58,24.26 6.9,24.26 6.36,23.72 4.78,23.72 3.48,25.03
  vias: v1(28.71,31.09)
EX_IOR27B_M11: length 36.7
  Top Layer w0.104: 29.7,33.09 U7.M11
  SIG03 w0.104: 6.02,25.03 7.19,26.2 7.2,26.19 7.74,26.19 7.81,26.12 7.81,25.58 7.88,25.51 8.06,25.51 8.14,25.58 8.14,26.12 8.21,26.19 8.39,26.19 8.46,26.12 8.46,25.58 8.54,25.51 8.72,25.51 8.79,25.58 8.79,26.12 8.87,26.19 9.05,26.19 9.12,26.12 9.12,25.58 9.19,25.51 9.37,25.51 9.45,25.58 9.45,26.12 9.52,26.19 9.7,26.19 9.77,26.12 9.77,25.58 9.85,25.51 10.03,25.51 10.1,25.58 10.1,26.12 10.18,26.19 10.36,26.19 10.43,26.12 10.43,25.58 10.5,25.51 10.68,25.51 10.76,25.58 10.76,26.12 10.83,26.19 11.01,26.19 11.09,26.12 11.09,25.58 11.16,25.51 11.34,25.51 11.41,25.58 11.41,26.12 11.49,26.19 11.7,26.19 11.77,26.12 11.77,25.86 11.84,25.79 12.02,25.79 12.1,25.86 12.1,26.12 12.17,26.19 18.05,26.19 19.57,27.71 25.54,27.71 26.32,28.49 26.32,30.38 27.62,31.68 27.84,31.68 28.32,32.17 28.32,32.32 28.48,32.47 28.73,32.47 29.35,33.09 29.7,33.09
  vias: v1(29.72,33.09)
EX_IOR29B_R8: length 32.6
  Top Layer w0.109: H6.22 41.63,35.19 42.66,34.16 42.66,32.01 41.92,31.27 38.69,31.27 37.92,30.49 37.92,28.78 35.87,26.73 34.87,26.73 33.27,25.13 33.27,24.16 33.35,24.08 33.52,24.08 33.6,24 33.6,23.83 33.52,23.75 33.35,23.75 33.27,23.68 33.27,23.53 33.11,23.37 31.17,23.37 31,23.2 31,22.19 30.93,22.12 30.75,22.12 30.67,22.19 30.67,23.27 30.52,23.42 30.06,23.42 29.94,23.54 29.94,25.52 29.29,26.18 28.08,26.18 27.59,26.66 27.59,29.2 U7.R8
